# EasyEDA Pro project 嵌入式.eprj, board 显示 (continued)
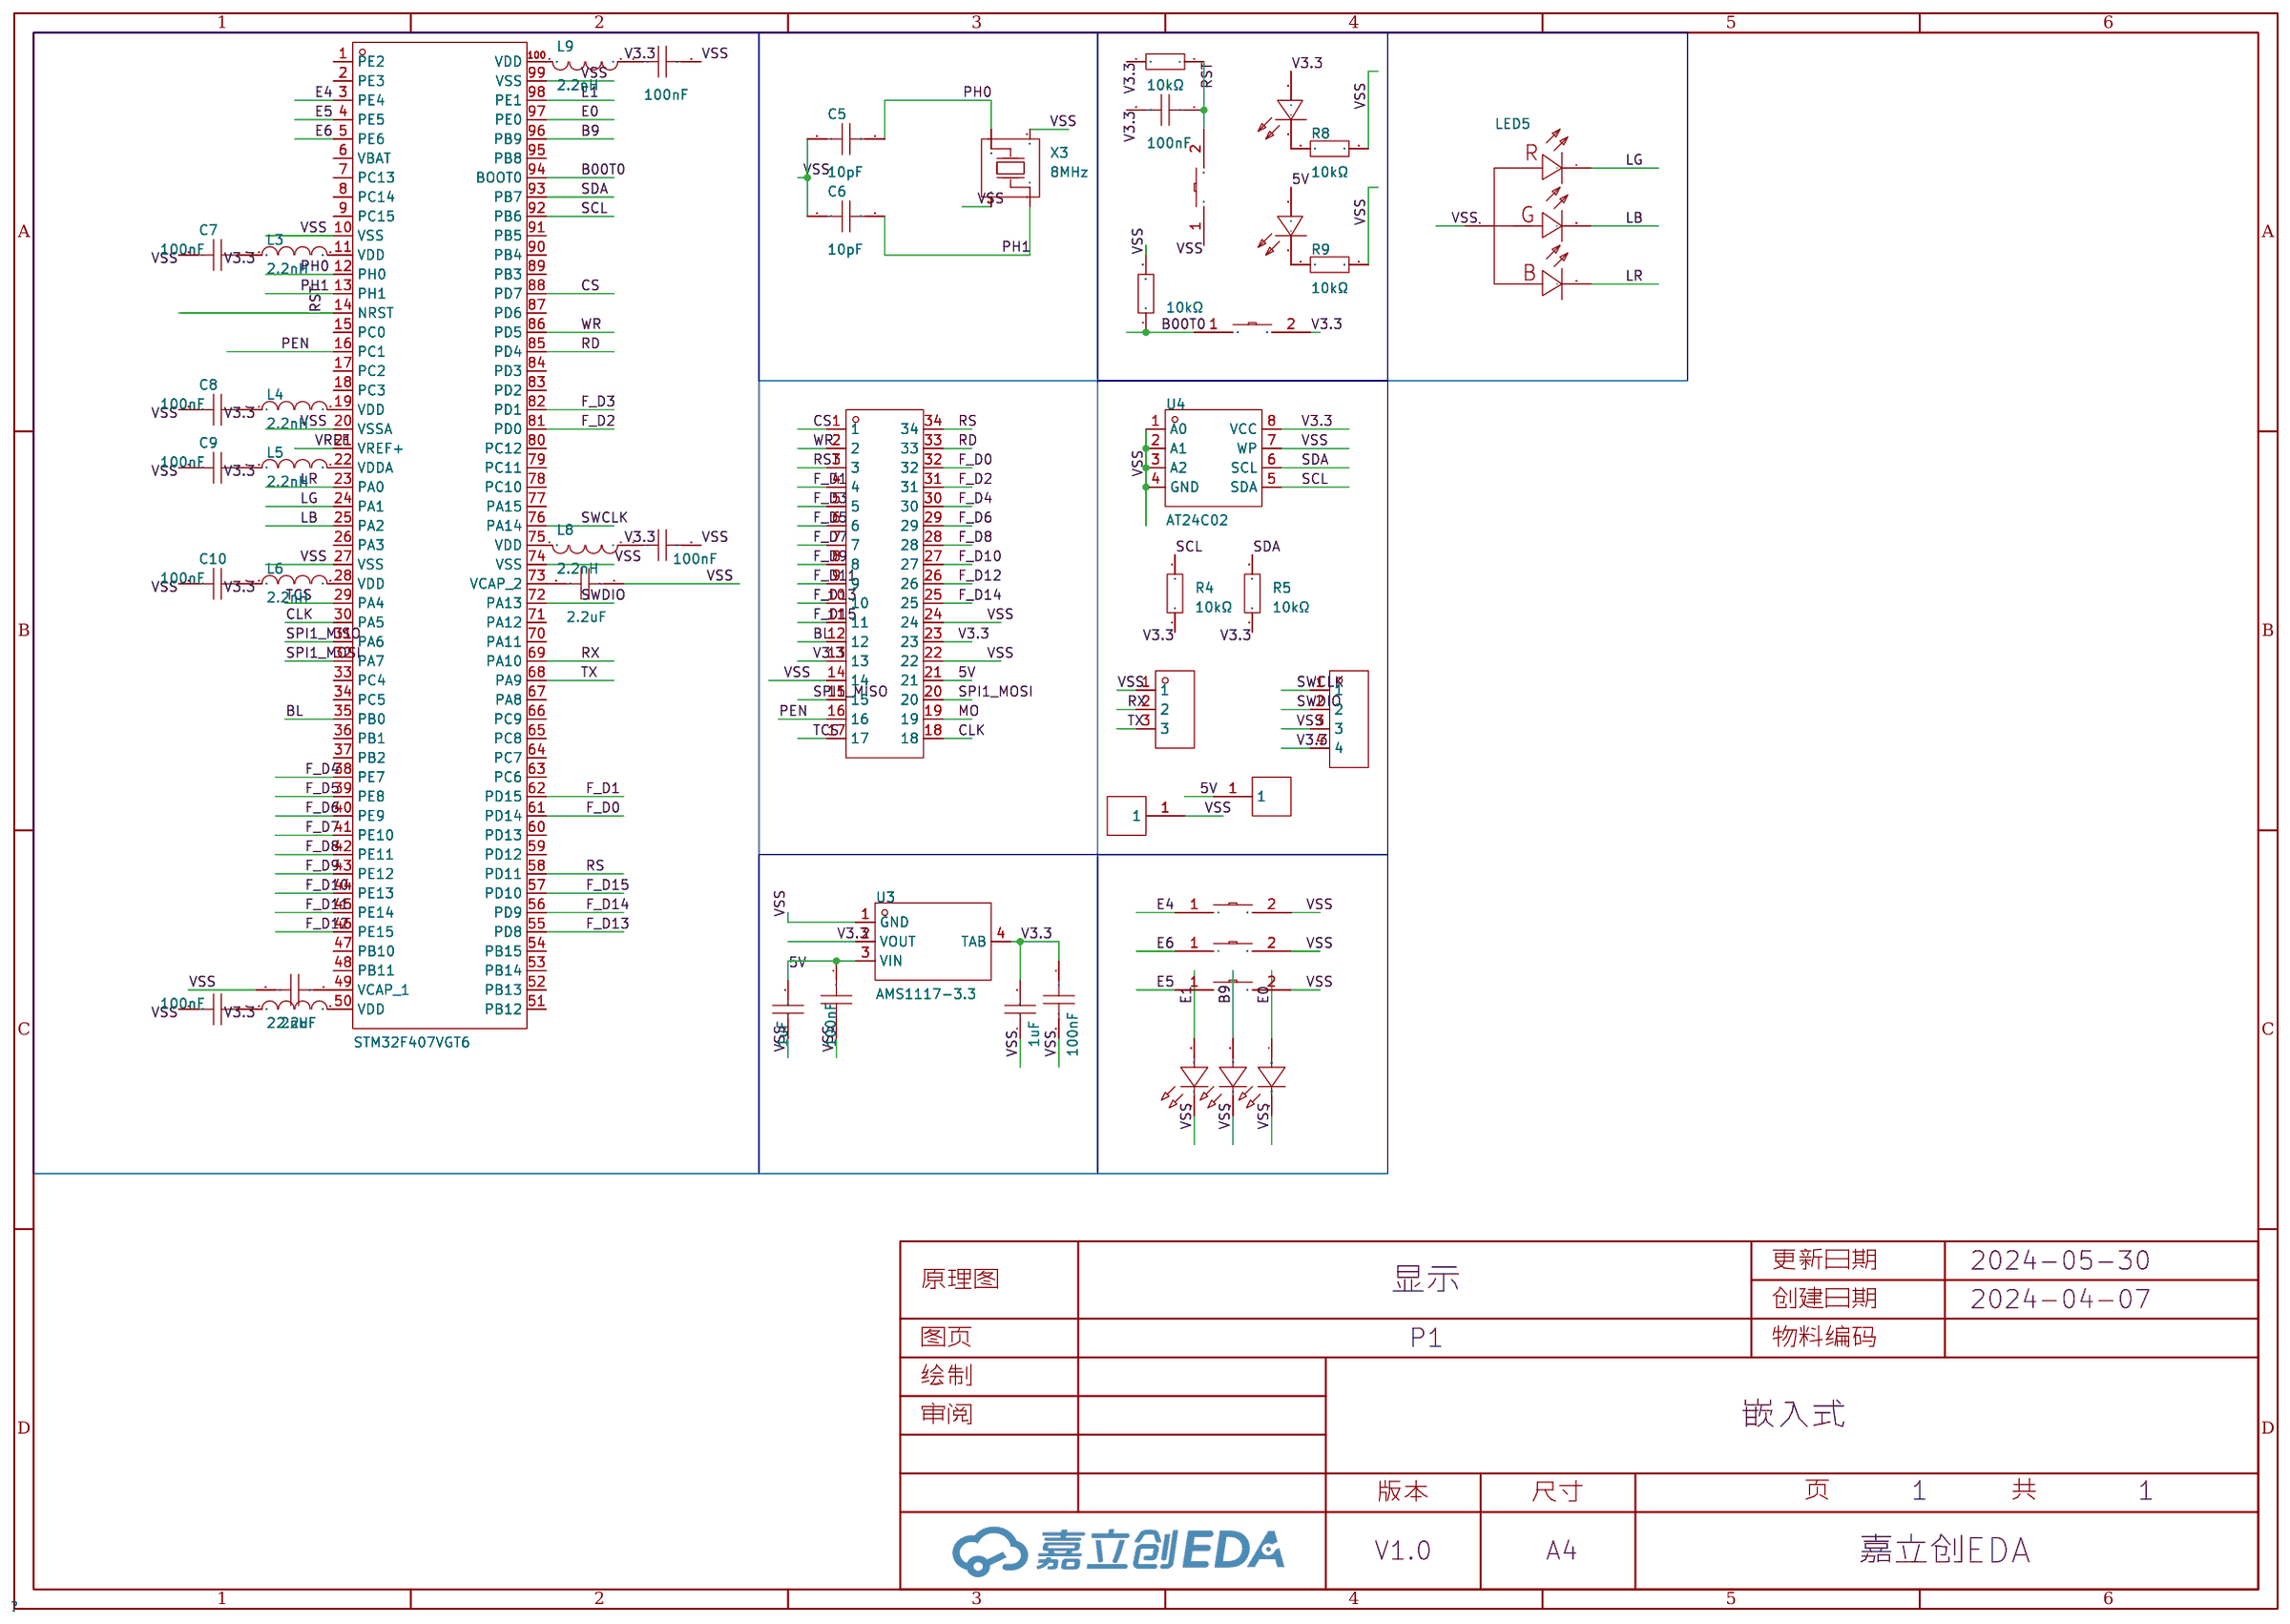
[diagram p0: schematic sheet]
## Routing (per net, layer and track width the routed paths; a pad name or vN(x,y) marks a point on that pad's centre or on a via; arc(x,y) is an arc through that point)
5V: length 166.9
  Top Layer w0.165: v3(25.49,10.33) 23.41,12.42 21.22,12.42 LED3.1
  Bottom Layer w0.381: U3.3 26.15,13.59 C18.1 25.59,11.89 C19.2 25.59,5.55 H2.1 ; NOREF#2.2 27.07,0.51 1.8,0.51 0.49,1.82 0.49,79.38 3.17,82.07 35.97,82.07 38.16,79.87
V3.3: length 186.8
  Top Layer w0.165: R4.1 30.99,28.45 v3(30.99,26.03) ; LED2.1 28.98,15.54 v3(30.66,17.22) ; SW3.2 42.88,43.88 v3(38.98,43.88) ; 31.83,26.03 R5.1
  Top Layer w0.254: 23.89,31.94 23.95,31.94 C12.1 25.25,30.61 v3(24.33,29.69) ; v3(30.11,56.45) 28.46,54.8 28.46,54.77 ; v3(11.18,42.8) 11.18,43.68 ; 11.18,43.68 C11.1 ; 11.18,43.68 11.23,43.74 L7.1 ; L3.1 36.16,46.29 v3(36.21,46.29) ; L6.1 22.97,55.16 C10.1 22.08,56.42 v3(24.14,58.48) 25.67,56.96 25.67,56.81 ; 37.58,42.1 37.58,42.48 v3(38.98,43.88) ; U4.8 35.66,26.03 v3(30.99,26.03)
  Bottom Layer w0.381: R6.2 49.23,71.37 41.62,71.37 U2.13 ; H1.4 30.99,10.84 U3.2 U3.4 ; U2.13 U2.23 ; U2.13 23.04,64.71 23.04,59.66 25.02,57.68 28.55,57.68 29.97,56.26 29.97,52.5 36.4,46.08 36.94,46.08 39.5,43.52 39.5,42.19 31.05,33.74 C20.1 30.99,27.04 v3(30.99,26.03) U3.4 ; U3.4 24.33,28.72 v3(24.33,29.69) 11.23,42.8 v3(11.18,42.8)
VSS: length 10.4
  Top Layer w0.165: v2(22.91,33.32) 22.91,33.6 U1.74 ; v2(25.17,53.9) 25.17,52.63 24.61,52.07 24.47,52.07 U1.27 ; v2(36.25,41.3) 35.24,41.3 U1.99 ; U1.20 26.37,49.78 25.2,49.78
  vias: v1(1.27,81.33) v1(1.27,79.3) v1(1.27,78.28) v1(1.27,77.27) v1(1.27,42.72) v1(1.27,41.71) v1(1.27,40.69) v1(1.27,39.67) v1(1.27,38.66) v1(1.27,37.64) v1(1.27,36.63) v1(1.27,35.61) v1(1.27,34.59) v1(1.27,33.58) v1(1.27,32.56) v1(1.27,31.55) v1(1.27,30.53) v1(1.27,29.51) v1(1.27,28.5) v1(1.27,27.48) v1(1.27,26.47) v1(1.27,25.45) v1(1.27,24.43) v1(1.27,23.42) v1(1.27,22.4) v1(1.27,21.39) v1(1.27,20.37) v1(1.27,19.35) v1(1.27,18.34) v1(1.27,17.32) v1(1.27,16.31) v1(1.27,15.29) v1(1.27,14.27) v1(1.27,13.26) v1(1.27,12.24) v1(1.27,11.23) v1(1.27,10.21) v1(1.27,9.19) v1(1.27,8.18) v1(1.27,7.16) v1(1.27,6.15) v1(1.27,5.13) v1(2.29,80.31) v1(2.29,79.3) v1(2.29,78.28) v1(2.29,76.25) v1(2.29,75.23) v1(2.29,74.22) v1(2.29,73.2) v1(2.29,72.19) v1(2.29,71.17) v1(2.29,70.15) v1(2.29,69.14) v1(2.29,68.12) v1(2.29,67.11) v1(2.29,66.09) v1(2.29,65.07) v1(2.29,64.06) v1(2.29,63.04) v1(2.29,62.03) v1(2.29,61.01) v1(2.29,59.99) v1(2.29,58.98) v1(2.29,57.96) v1(2.29,56.95) v1(2.29,55.93) v1(2.29,54.91) v1(2.29,53.9) v1(2.29,52.88) v1(2.29,51.87) v1(2.29,50.85) v1(2.29,49.83) v1(2.29,48.82) v1(2.29,47.8) v1(2.29,46.79) v1(2.29,45.77) v1(2.29,44.75) v1(2.29,41.71) v1(2.29,40.69) v1(2.29,39.67) v1(2.29,38.66) v1(2.29,37.64) v1(2.29,36.63) v1(2.29,35.61) v1(2.29,34.59) v1(2.29,33.58) v1(2.29,32.56) v1(2.29,31.55) v1(2.29,30.53) v1(2.29,29.51) v1(2.29,28.5) v1(2.29,27.48) v1(2.29,26.47) v1(2.29,25.45) v1(2.29,24.43) v1(2.29,23.42) v1(2.29,22.4) v1(2.29,21.39) v1(2.29,20.37) v1(2.29,19.35) v1(2.29,18.34) v1(2.29,17.32) v1(2.29,16.31) v1(2.29,15.29) v1(2.29,14.27) v1(2.29,13.26) v1(2.29,12.24) v1(2.29,11.23) v1(2.29,10.21) v1(2.29,9.19) v1(2.29,8.18) v1(2.29,7.16) v1(2.29,6.15) v1(3.3,81.33) v1(3.3,80.31) v1(3.3,79.3) v1(3.3,77.27) v1(3.3,76.25) v1(3.3,75.23) v1(3.3,74.22) v1(3.3,73.2) v1(3.3,72.19) v1(3.3,71.17) v1(3.3,70.15) v1(3.3,69.14) v1(3.3,68.12) v1(3.3,67.11) v1(3.3,66.09) v1(3.3,65.07) v1(3.3,64.06) v1(3.3,63.04) v1(3.3,62.03) v1(3.3,61.01) v1(3.3,59.99) v1(3.3,58.98) v1(3.3,57.96) v1(3.3,56.95) v1(3.3,55.93) v1(3.3,54.91) v1(3.3,53.9) v1(3.3,52.88) v1(3.3,51.87) v1(3.3,50.85) v1(3.3,49.83) v1(3.3,48.82) v1(3.3,47.8) v1(3.3,46.79) v1(3.3,45.77) v1(3.3,44.75) v1(3.3,43.74) v1(3.3,40.69) v1(3.3,39.67) v1(3.3,38.66) v1(3.3,37.64) v1(3.3,36.63) v1(3.3,35.61) v1(3.3,34.59) v1(3.3,33.58) v1(3.3,32.56) v1(3.3,31.55) v1(3.3,30.53) v1(3.3,29.51) v1(3.3,28.5) v1(3.3,27.48) v1(3.3,26.47) v1(3.3,25.45) v1(3.3,24.43) v1(3.3,23.42) v1(3.3,22.4) v1(3.3,21.39) v1(3.3,20.37) v1(3.3,19.35) v1(3.3,18.34) v1(3.3,17.32) v1(3.3,16.31) v1(3.3,15.29) v1(3.3,14.27) v1(3.3,13.26) v1(3.3,12.24) v1(3.3,11.23) v1(3.3,10.21) v1(3.3,9.19) v1(3.3,8.18) v1(3.3,7.16) v1(3.3,6.15) v1(4.32,81.33) v1(4.32,75.23) v1(4.32,74.22) v1(4.32,73.2) v1(4.32,72.19) v1(4.32,71.17) v1(4.32,70.15) v1(4.32,69.14) v1(4.32,68.12) v1(4.32,67.11) v1(4.32,66.09) v1(4.32,65.07) v1(4.32,64.06) v1(4.32,63.04) v1(4.32,62.03) v1(4.32,61.01) v1(4.32,59.99) v1(4.32,58.98) v1(4.32,57.96) v1(4.32,56.95) v1(4.32,55.93) v1(4.32,54.91) v1(4.32,53.9) v1(4.32,52.88) v1(4.32,51.87) v1(4.32,50.85) v1(4.32,49.83) v1(4.32,48.82) v1(4.32,47.8) v1(4.32,46.79) v1(4.32,45.77) v1(4.32,44.75) v1(4.32,43.74) v1(4.32,42.72) v1(4.32,39.67) v1(4.32,38.66) v1(4.32,37.64) v1(4.32,36.63) v1(4.32,35.61) v1(4.32,34.59) v1(4.32,33.58) v1(4.32,32.56) v1(4.32,31.55) v1(4.32,30.53) v1(4.32,29.51) v1(4.32,28.5) v1(4.32,27.48) v1(4.32,26.47) v1(4.32,25.45) v1(4.32,24.43) v1(4.32,23.42) v1(4.32,22.4) v1(4.32,21.39) v1(4.32,20.37) v1(4.32,19.35) v1(4.32,18.34) v1(4.32,17.32) v1(4.32,16.31) v1(4.32,15.29) v1(4.32,14.27) v1(4.32,13.26) v1(4.32,12.24) v1(4.32,11.23) v1(4.32,10.21) v1(4.32,9.19) v1(4.32,8.18) v1(4.32,7.16) v1(4.32,6.15) v1(5.33,81.33) v1(5.33,38.66) v1(5.33,37.64) v1(5.33,36.63) v1(5.33,35.61) v1(5.33,34.59) v1(5.33,33.58) v1(5.33,32.56) v1(5.33,31.55) v1(5.33,30.53) v1(5.33,29.51) v1(5.33,28.5) v1(5.33,27.48) v1(5.33,26.47) v1(5.33,25.45) v1(5.33,24.43) v1(5.33,23.42) v1(5.33,22.4) v1(5.33,21.39) v1(5.33,20.37) v1(5.33,19.35) v1(5.33,18.34) v1(5.33,17.32) v1(5.33,16.31) v1(5.33,15.29) v1(5.33,14.27) v1(5.33,13.26) v1(5.33,12.24) v1(5.33,11.23) v1(5.33,10.21) v1(5.33,9.19) v1(5.33,8.18) v1(5.33,7.16) v1(5.33,6.15) v1(5.33,5.13) v1(6.35,81.33) v1(6.35,75.23) v1(6.35,74.22) v1(6.35,73.2) v1(6.35,72.19) v1(6.35,71.17) v1(6.35,70.15) v1(6.35,69.14) v1(6.35,68.12) v1(6.35,67.11) v1(6.35,66.09) v1(6.35,65.07) v1(6.35,64.06) v1(6.35,63.04) v1(6.35,62.03) v1(6.35,61.01) v1(6.35,59.99) v1(6.35,58.98) v1(6.35,57.96) v1(6.35,56.95) v1(6.35,55.93) v1(6.35,54.91) v1(6.35,53.9) v1(6.35,52.88) v1(6.35,51.87) v1(6.35,50.85) v1(6.35,49.83) v1(6.35,48.82) v1(6.35,47.8) v1(6.35,46.79) v1(6.35,45.77) v1(6.35,44.75) v1(6.35,43.74) v1(6.35,42.72) v1(6.35,41.71) v1(6.35,37.64) v1(6.35,36.63) v1(6.35,35.61) v1(6.35,34.59) v1(6.35,33.58) v1(6.35,32.56) v1(6.35,31.55) v1(6.35,30.53) v1(6.35,29.51) v1(6.35,28.5) v1(6.35,27.48) v1(6.35,26.47) v1(6.35,25.45) v1(6.35,24.43) v1(6.35,23.42) v1(6.35,22.4) v1(6.35,21.39) v1(6.35,20.37) v1(6.35,19.35) v1(6.35,18.34) v1(6.35,17.32) v1(6.35,16.31) v1(6.35,15.29) v1(6.35,14.27) v1(6.35,13.26) v1(6.35,12.24) v1(6.35,11.23) v1(6.35,10.21) v1(6.35,9.19) v1(6.35,8.18) v1(6.35,7.16) v1(6.35,6.15) v1(6.35,5.13) v1(6.35,4.11) v1(6.35,3.1) v1(6.35,2.08) v1(7.37,81.33) v1(7.37,53.9) v1(7.37,52.88) v1(7.37,51.87) v1(7.37,50.85) v1(7.37,49.83) v1(7.37,48.82) v1(7.37,47.8) v1(7.37,46.79) v1(7.37,45.77) v1(7.37,44.75) v1(7.37,43.74) v1(7.37,42.72) v1(7.37,41.71) v1(7.37,40.69) v1(7.37,36.63) v1(7.37,35.61) v1(7.37,34.59) v1(7.37,33.58) v1(7.37,32.56) v1(7.37,31.55) v1(7.37,30.53) v1(7.37,29.51) v1(7.37,28.5) v1(7.37,27.48) v1(7.37,26.47) v1(7.37,25.45) v1(7.37,24.43) v1(7.37,23.42) v1(7.37,22.4) v1(7.37,21.39) v1(7.37,20.37) v1(7.37,19.35) v1(7.37,18.34) v1(7.37,17.32) v1(7.37,16.31) v1(7.37,15.29) v1(7.37,14.27) v1(7.37,13.26) v1(7.37,12.24) v1(7.37,11.23) v1(7.37,10.21) v1(7.37,9.19) v1(7.37,8.18) v1(7.37,7.16) v1(7.37,6.15) v1(7.37,5.13) v1(7.37,4.11) v1(7.37,3.1) v1(7.37,2.08) v1(8.38,81.33) v1(8.38,75.23) v1(8.38,74.22) v1(8.38,73.2) v1(8.38,72.19) v1(8.38,71.17) v1(8.38,70.15) v1(8.38,69.14) v1(8.38,68.12) v1(8.38,67.11) v1(8.38,66.09) v1(8.38,65.07) v1(8.38,64.06) v1(8.38,63.04) v1(8.38,62.03) v1(8.38,61.01) v1(8.38,59.99) v1(8.38,58.98) v1(8.38,57.96) v1(8.38,56.95) v1(8.38,55.93) v1(8.38,52.88) v1(8.38,51.87) v1(8.38,50.85) v1(8.38,49.83) v1(8.38,48.82) v1(8.38,47.8) v1(8.38,46.79) v1(8.38,45.77) v1(8.38,44.75) v1(8.38,43.74) v1(8.38,42.72) v1(8.38,41.71) v1(8.38,40.69) v1(8.38,39.67) v1(8.38,35.61) v1(8.38,34.59) v1(8.38,33.58) v1(8.38,32.56) v1(8.38,31.55) v1(8.38,30.53) v1(8.38,29.51) v1(8.38,28.5) v1(8.38,27.48) v1(8.38,26.47) v1(8.38,25.45) v1(8.38,24.43) v1(8.38,23.42) v1(8.38,22.4) v1(8.38,21.39) v1(8.38,20.37) v1(8.38,19.35) v1(8.38,18.34) v1(8.38,17.32) v1(8.38,16.31) v1(8.38,15.29) v1(8.38,14.27) v1(8.38,13.26) v1(8.38,12.24) v1(8.38,11.23) v1(8.38,10.21) v1(8.38,9.19) v1(8.38,8.18) v1(8.38,7.16) v1(8.38,6.15) v1(8.38,5.13) v1(8.38,4.11) v1(8.38,3.1) v1(8.38,2.08) v1(9.4,81.33) v1(9.4,51.87) v1(9.4,50.85) v1(9.4,49.83) v1(9.4,48.82) v1(9.4,47.8) v1(9.4,46.79) v1(9.4,45.77) v1(9.4,44.75) v1(9.4,42.72) v1(9.4,41.71) v1(9.4,40.69) v1(9.4,39.67) v1(9.4,38.66) v1(9.4,35.61) v1(9.4,34.59) v1(9.4,33.58) v1(9.4,32.56) v1(9.4,31.55) v1(9.4,30.53) v1(9.4,29.51) v1(9.4,28.5) v1(9.4,27.48) v1(9.4,26.47) v1(9.4,25.45) v1(9.4,24.43) v1(9.4,23.42) v1(9.4,22.4) v1(9.4,21.39) v1(9.4,20.37) v1(9.4,19.35) v1(9.4,18.34) v1(9.4,17.32) v1(9.4,16.31) v1(9.4,15.29) v1(9.4,14.27) v1(9.4,13.26) v1(9.4,12.24) v1(9.4,11.23) v1(9.4,10.21) v1(9.4,9.19) v1(9.4,8.18) v1(9.4,7.16) v1(9.4,6.15) v1(9.4,5.13) v1(9.4,4.11) v1(9.4,3.1) v1(9.4,2.08) v1(10.41,81.33) v1(10.41,75.23) v1(10.41,74.22) v1(10.41,73.2) v1(10.41,72.19) v1(10.41,71.17) v1(10.41,70.15) v1(10.41,69.14) v1(10.41,68.12) v1(10.41,67.11) v1(10.41,66.09) v1(10.41,65.07) v1(10.41,63.04) v1(10.41,62.03) v1(10.41,61.01) v1(10.41,59.99) v1(10.41,58.98) v1(10.41,57.96) v1(10.41,56.95) v1(10.41,55.93) v1(10.41,54.91) v1(10.41,50.85) v1(10.41,49.83) v1(10.41,48.82) v1(10.41,45.77) v1(10.41,44.75) v1(10.41,40.69) v1(10.41,39.67) v1(10.41,38.66) v1(10.41,37.64) v1(10.41,35.61) v1(10.41,34.59) v1(10.41,33.58) v1(10.41,32.56) v1(10.41,31.55) v1(10.41,30.53) v1(10.41,29.51) v1(10.41,28.5) v1(10.41,27.48) v1(10.41,26.47) v1(10.41,25.45) v1(10.41,24.43) v1(10.41,23.42) v1(10.41,22.4) v1(10.41,21.39) v1(10.41,20.37) v1(10.41,19.35) v1(10.41,18.34) v1(10.41,17.32) v1(10.41,16.31) v1(10.41,15.29) v1(10.41,14.27) v1(10.41,13.26) v1(10.41,12.24) v1(10.41,11.23) v1(10.41,10.21) v1(10.41,9.19) v1(10.41,8.18) v1(10.41,7.16) v1(10.41,6.15) v1(10.41,5.13) v1(10.41,4.11) v1(10.41,3.1) v1(10.41,2.08) v1(11.43,39.67) v1(11.43,38.66) v1(11.43,37.64) v1(11.43,34.59) v1(11.43,33.58) v1(11.43,32.56) v1(11.43,31.55) v1(11.43,30.53) v1(11.43,29.51) v1(11.43,28.5) v1(11.43,27.48) v1(11.43,26.47) v1(11.43,25.45) v1(11.43,24.43) v1(11.43,23.42) v1(11.43,22.4) v1(11.43,21.39) v1(11.43,20.37) v1(11.43,19.35) v1(11.43,18.34) v1(11.43,17.32) v1(11.43,16.31) v1(11.43,15.29) v1(11.43,14.27) v1(11.43,13.26) v1(11.43,12.24) v1(11.43,11.23) v1(11.43,10.21) v1(11.43,9.19) v1(11.43,8.18) v1(11.43,7.16) v1(11.43,6.15) v1(11.43,5.13) v1(11.43,4.11) v1(11.43,3.1) v1(11.43,2.08) v1(12.45,75.23) v1(12.45,74.22) v1(12.45,73.2) v1(12.45,72.19) v1(12.45,71.17) v1(12.45,70.15) v1(12.45,69.14) v1(12.45,68.12) v1(12.45,67.11) v1(12.45,66.09) v1(12.45,65.07) v1(12.45,64.06) v1(12.45,63.04) v1(12.45,62.03) v1(12.45,61.01) v1(12.45,59.99) v1(12.45,58.98) v1(12.45,57.96) v1(12.45,56.95) v1(12.45,55.93) v1(12.45,54.91) v1(12.45,53.9) v1(12.45,52.88) v1(12.45,48.82) v1(12.45,38.66) v1(12.45,37.64) v1(12.45,35.61) v1(12.45,33.58) v1(12.45,32.56) v1(12.45,31.55) v1(12.45,30.53) v1(12.45,29.51) v1(12.45,28.5) v1(12.45,9.19) v1(12.45,8.18) v1(12.45,7.16) v1(12.45,6.15) v1(12.45,5.13) v1(12.45,4.11) v1(12.45,3.1) v1(12.45,2.08) v1(13.46,81.33) v1(13.46,37.64) v1(13.46,35.61) v1(13.46,34.59) v1(13.46,32.56) v1(13.46,31.55) v1(13.46,30.53) v1(13.46,29.51) v1(13.46,8.18) v1(13.46,7.16) v1(13.46,6.15) v1(13.46,5.13) v1(13.46,4.11) v1(13.46,3.1) v1(13.46,2.08) v1(14.48,81.33) v1(14.48,35.61) v1(14.48,34.59) v1(14.48,33.58) v1(14.48,31.55) v1(14.48,30.53) v1(14.48,27.48) v1(14.48,26.47) v1(14.48,25.45) v1(14.48,24.43) v1(14.48,23.42) v1(14.48,22.4) v1(14.48,21.39) v1(14.48,20.37) v1(14.48,19.35) v1(14.48,18.34) v1(14.48,17.32) v1(14.48,16.31) v1(14.48,14.27) v1(14.48,13.26) v1(14.48,7.16) v1(14.48,6.15) v1(14.48,5.13) v1(14.48,4.11) v1(14.48,3.1) v1(14.48,2.08) v1(15.49,81.33) v1(15.49,35.61) v1(15.49,34.59) v1(15.49,33.58) v1(15.49,31.55) v1(15.49,28.5) v1(15.49,27.48) v1(15.49,26.47) v1(15.49,25.45) v1(15.49,24.43) v1(15.49,23.42) v1(15.49,22.4) v1(15.49,21.39) v1(15.49,20.37) v1(15.49,19.35) v1(15.49,18.34) v1(15.49,17.32) v1(15.49,14.27) v1(15.49,11.23) v1(15.49,6.15) v1(15.49,5.13) v1(15.49,4.11) v1(15.49,3.1) v1(15.49,2.08) v1(16.51,81.33) v1(16.51,34.59) v1(16.51,33.58) v1(16.51,29.51) v1(16.51,28.5) v1(16.51,27.48) v1(16.51,26.47) v1(16.51,25.45) v1(16.51,24.43) v1(16.51,23.42) v1(16.51,22.4) v1(16.51,21.39) v1(16.51,20.37) v1(16.51,19.35) v1(16.51,18.34) v1(16.51,17.32) v1(16.51,14.27) v1(16.51,11.23) v1(16.51,6.15) v1(16.51,5.13) v1(16.51,4.11) v1(16.51,3.1) v1(16.51,2.08) v1(17.53,81.33) v1(17.53,35.61) v1(17.53,34.59) v1(17.53,33.58) v1(17.53,30.53) v1(17.53,29.51) v1(17.53,28.5) v1(17.53,27.48) v1(17.53,26.47) v1(17.53,25.45) v1(17.53,24.43) v1(17.53,23.42) v1(17.53,22.4) v1(17.53,21.39) v1(17.53,20.37) v1(17.53,19.35) v1(17.53,18.34) v1(17.53,17.32) v1(17.53,16.31) v1(17.53,14.27) v1(17.53,13.26) v1(17.53,11.23) v1(17.53,6.15) v1(17.53,5.13) v1(17.53,4.11) v1(17.53,3.1) v1(17.53,2.08) v1(18.54,81.33) v1(18.54,36.63) v1(18.54,34.59) v1(18.54,31.55) v1(18.54,30.53) v1(18.54,29.51) v1(18.54,28.5) v1(18.54,27.48) v1(18.54,26.47) v1(18.54,25.45) v1(18.54,24.43) v1(18.54,23.42) v1(18.54,22.4) v1(18.54,21.39) v1(18.54,20.37) v1(18.54,19.35) v1(18.54,18.34) v1(18.54,17.32) v1(18.54,11.23) v1(18.54,10.21) v1(18.54,6.15) v1(18.54,5.13) v1(18.54,4.11) v1(18.54,3.1) v1(18.54,2.08) v1(19.56,81.33) v1(19.56,35.61) v1(19.56,25.45) v1(19.56,24.43) v1(19.56,23.42) v1(19.56,22.4) v1(19.56,21.39) v1(19.56,20.37) v1(19.56,19.35) v1(19.56,18.34) v1(19.56,17.32) v1(19.56,11.23) v1(19.56,10.21) v1(19.56,9.19) v1(19.56,6.15) v1(19.56,5.13) v1(19.56,4.11) v1(19.56,3.1) v1(19.56,2.08) v1(20.57,81.33) v1(20.57,40.69) v1(20.57,29.51) v1(20.57,28.5) v1(20.57,27.48) v1(20.57,24.43) v1(20.57,23.42) v1(20.57,22.4) v1(20.57,21.39) v1(20.57,20.37) v1(20.57,19.35) v1(20.57,18.34) v1(20.57,17.32) v1(20.57,11.23) v1(20.57,10.21) v1(20.57,9.19) v1(20.57,6.15) v1(20.57,5.13) v1(20.57,4.11) v1(20.57,3.1) v1(20.57,2.08) v1(21.59,81.33) v1(21.59,39.67) v1(21.59,27.48) v1(21.59,26.47) v1(21.59,23.42) v1(21.59,22.4) v1(21.59,21.39) v1(21.59,20.37) v1(21.59,19.35) v1(21.59,18.34) v1(21.59,17.32) v1(21.59,11.23) v1(21.59,10.21) v1(21.59,9.19) v1(21.59,6.15) v1(21.59,5.13) v1(21.59,4.11) v1(21.59,3.1) v1(21.59,2.08) v1(22.61,81.33) v1(22.61,73.2) v1(22.61,72.19) v1(22.61,71.17) v1(22.61,70.15) v1(22.61,69.14) v1(22.61,68.12) v1(22.61,67.11) v1(22.61,66.09) v1(22.61,47.8) v1(22.61,42.72) v1(22.61,38.66) v1(22.61,29.51) v1(22.61,28.5) v1(22.61,27.48) v1(22.61,26.47) v1(22.61,25.45) v1(22.61,22.4) v1(22.61,21.39) v1(22.61,20.37) v1(22.61,19.35) v1(22.61,18.34) v1(22.61,17.32) v1(22.61,16.31) v1(22.61,14.27) v1(22.61,13.26) v1(22.61,11.23) v1(22.61,10.21) v1(22.61,9.19) v1(22.61,6.15) v1(22.61,5.13) v1(22.61,4.11) v1(22.61,3.1) v1(22.61,2.08) v1(23.62,81.33) v1(23.62,74.22) v1(23.62,73.2) v1(23.62,72.19) v1(23.62,71.17) v1(23.62,70.15) v1(23.62,69.14) v1(23.62,68.12) v1(23.62,67.11) v1(23.62,48.82) v1(23.62,47.8) v1(23.62,43.74) v1(23.62,42.72) v1(23.62,41.71) v1(23.62,38.66) v1(23.62,37.64) v1(23.62,28.5) v1(23.62,27.48) v1(23.62,26.47) v1(23.62,25.45) v1(23.62,24.43) v1(23.62,21.39) v1(23.62,20.37) v1(23.62,19.35) v1(23.62,18.34) v1(23.62,17.32) v1(23.62,16.31) v1(23.62,14.27) v1(23.62,13.26) v1(23.62,10.21) v1(23.62,9.19) v1(23.62,6.15) v1(23.62,5.13) v1(23.62,4.11) v1(23.62,3.1) v1(23.62,2.08) v1(24.64,81.33) v1(24.64,75.23) v1(24.64,74.22) v1(24.64,73.2) v1(24.64,72.19) v1(24.64,71.17) v1(24.64,70.15) v1(24.64,69.14) v1(24.64,68.12) v1(24.64,65.07) v1(24.64,64.06) v1(24.64,63.04) v1(24.64,59.99) v1(24.64,55.93) v1(24.64,48.82) v1(24.64,44.75) v1(24.64,43.74) v1(24.64,42.72) v1(24.64,41.71) v1(24.64,38.66) v1(24.64,37.64) v1(24.64,27.48) v1(24.64,26.47) v1(24.64,25.45) v1(24.64,24.43) v1(24.64,23.42) v1(24.64,20.37) v1(24.64,19.35) v1(24.64,18.34) v1(24.64,17.32) v1(24.64,16.31) v1(24.64,14.27) v1(24.64,13.26) v1(24.64,12.24) v1(24.64,9.19) v1(24.64,8.18) v1(24.64,7.16) v1(24.64,6.15) v1(24.64,5.13) v1(24.64,4.11) v1(24.64,3.1) v1(24.64,2.08) v1(25.65,81.33) v1(25.65,75.23) v1(25.65,74.22) v1(25.65,73.2) v1(25.65,72.19) v1(25.65,71.17) v1(25.65,70.15) v1(25.65,69.14) v1(25.65,66.09) v1(25.65,65.07) v1(25.65,64.06) v1(25.65,61.01) v1(25.65,59.99) v1(25.65,49.83) v1(25.65,45.77) v1(25.65,44.75) v1(25.65,43.74) v1(25.65,42.72) v1(25.65,41.71) v1(25.65,38.66) v1(25.65,37.64) v1(25.65,29.51) v1(25.65,28.5) v1(25.65,26.47) v1(25.65,25.45) v1(25.65,24.43) v1(25.65,23.42) v1(25.65,22.4) v1(25.65,19.35) v1(25.65,18.34) v1(25.65,17.32) v1(25.65,16.31) v1(25.65,14.27) v1(25.65,4.11) v1(25.65,3.1) v1(25.65,2.08) v1(26.67,81.33) v1(26.67,46.79) v1(26.67,45.77) v1(26.67,43.74) v1(26.67,42.72) v1(26.67,41.71) v1(26.67,38.66) v1(26.67,30.53) v1(26.67,29.51) v1(26.67,28.5) v1(26.67,27.48) v1(26.67,25.45) v1(26.67,24.43) v1(26.67,23.42) v1(26.67,22.4) v1(26.67,21.39) v1(26.67,18.34) v1(26.67,17.32) v1(26.67,16.31) v1(26.67,11.23) v1(26.67,9.19) v1(26.67,6.15) v1(26.67,3.1) v1(26.67,2.08) v1(27.69,81.33) v1(27.69,47.8) v1(27.69,46.79) v1(27.69,45.77) v1(27.69,44.75) v1(27.69,43.74) v1(27.69,42.72) v1(27.69,41.71) v1(27.69,40.69) v1(27.69,31.55) v1(27.69,30.53) v1(27.69,29.51) v1(27.69,28.5) v1(27.69,27.48) v1(27.69,26.47) v1(27.69,24.43) v1(27.69,23.42) v1(27.69,22.4) v1(27.69,21.39) v1(27.69,18.34) v1(27.69,17.32) v1(27.69,16.31) v1(27.69,14.27) v1(27.69,13.26) v1(27.69,9.19) v1(27.69,5.13) v1(28.7,81.33) v1(28.7,75.23) v1(28.7,74.22) v1(28.7,73.2) v1(28.7,72.19) v1(28.7,69.14) v1(28.7,68.12) v1(28.7,67.11) v1(28.7,64.06) v1(28.7,63.04) v1(28.7,59.99) v1(28.7,47.8) v1(28.7,46.79) v1(28.7,45.77) v1(28.7,44.75) v1(28.7,43.74) v1(28.7,42.72) v1(28.7,41.71) v1(28.7,40.69) v1(28.7,39.67) v1(28.7,23.42) v1(28.7,22.4) v1(28.7,21.39) v1(28.7,18.34) v1(28.7,14.27) v1(28.7,13.26) v1(28.7,12.24) v1(28.7,11.23) v1(28.7,10.21) v1(28.7,6.15) v1(28.7,5.13) v1(29.72,81.33) v1(29.72,75.23) v1(29.72,74.22) v1(29.72,73.2) v1(29.72,70.15) v1(29.72,69.14) v1(29.72,68.12) v1(29.72,65.07) v1(29.72,64.06) v1(29.72,61.01) v1(29.72,46.79) v1(29.72,45.77) v1(29.72,43.74) v1(29.72,42.72) v1(29.72,41.71) v1(29.72,40.69) v1(29.72,39.67) v1(29.72,32.56) v1(29.72,31.55) v1(29.72,30.53) v1(29.72,29.51) v1(29.72,27.48) v1(29.72,26.47) v1(29.72,18.34) v1(29.72,17.32) v1(29.72,15.29) v1(29.72,14.27) v1(29.72,13.26) v1(29.72,12.24) v1(29.72,11.23) v1(29.72,6.15) v1(29.72,5.13) v1(29.72,4.11) v1(29.72,3.1) v1(29.72,2.08) v1(29.72,1.07) v1(30.73,81.33) v1(30.73,41.71) v1(30.73,40.69) v1(30.73,9.19) v1(30.73,6.15) v1(30.73,5.13) v1(30.73,4.11) v1(30.73,3.1) v1(30.73,2.08) v1(30.73,1.07) v1(31.75,81.33) v1(31.75,79.3) v1(31.75,78.28) v1(31.75,76.25) v1(31.75,75.23) v1(31.75,72.19) v1(31.75,71.17) v1(31.75,70.15) v1(31.75,67.11) v1(31.75,63.04) v1(31.75,51.87) v1(31.75,41.71) v1(31.75,33.58) v1(31.75,32.56) v1(31.75,31.55) v1(31.75,20.37) v1(31.75,19.35) v1(31.75,14.27) v1(31.75,13.26) v1(31.75,12.24) v1(31.75,11.23) v1(31.75,10.21) v1(31.75,9.19) v1(31.75,6.15) v1(31.75,5.13) v1(31.75,4.11) v1(31.75,3.1) v1(31.75,2.08) v1(31.75,1.07) v1(32.77,81.33) v1(32.77,68.12) v1(32.77,64.06) v1(32.77,54.91) v1(32.77,42.72) v1(32.77,37.64) v1(32.77,34.59) v1(32.77,33.58) v1(32.77,32.56) v1(32.77,31.55) v1(32.77,30.53) v1(32.77,20.37) v1(32.77,19.35) v1(32.77,18.34) v1(32.77,5.13) v1(32.77,4.11) v1(32.77,3.1) v1(32.77,2.08) v1(32.77,1.07) v1(33.78,81.33) v1(33.78,69.14) v1(33.78,65.07) v1(33.78,58.98) v1(33.78,57.96) v1(33.78,55.93) v1(33.78,52.88) v1(33.78,51.87) v1(33.78,35.61) v1(33.78,34.59) v1(33.78,33.58) v1(33.78,32.56) v1(33.78,31.55) v1(33.78,23.42) v1(33.78,22.4) v1(33.78,19.35) v1(33.78,18.34) v1(33.78,14.27) v1(33.78,13.26) v1(33.78,12.24) v1(33.78,11.23) v1(33.78,10.21) v1(33.78,9.19) v1(33.78,6.15) v1(33.78,5.13) v1(34.8,81.33) v1(34.8,75.23) v1(34.8,74.22) v1(34.8,73.2) v1(34.8,72.19) v1(34.8,71.17) v1(34.8,70.15) v1(34.8,66.09) v1(34.8,59.99) v1(34.8,58.98) v1(34.8,52.88) v1(34.8,27.48) v1(34.8,24.43) v1(34.8,23.42) v1(34.8,22.4) v1(34.8,21.39) v1(34.8,5.13) v1(35.81,81.33) v1(35.81,75.23) v1(35.81,74.22) v1(35.81,73.2) v1(35.81,72.19) v1(35.81,71.17) v1(35.81,67.11) v1(35.81,61.01) v1(35.81,59.99) v1(35.81,48.82) v1(35.81,47.8) v1(35.81,27.48) v1(35.81,24.43) v1(35.81,23.42) v1(35.81,22.4) v1(35.81,21.39) v1(35.81,20.37) v1(35.81,5.13) v1(35.81,4.11) v1(35.81,3.1) v1(35.81,2.08) v1(35.81,1.07) v1(36.83,79.3) v1(36.83,78.28) v1(36.83,75.23) v1(36.83,74.22) v1(36.83,73.2) v1(36.83,72.19) v1(36.83,68.12) v1(36.83,62.03) v1(36.83,61.01) v1(36.83,56.95) v1(36.83,48.82) v1(36.83,40.69) v1(36.83,25.45) v1(36.83,24.43) v1(36.83,23.42) v1(36.83,22.4) v1(36.83,21.39) v1(36.83,20.37) v1(36.83,19.35) v1(36.83,18.34) v1(36.83,17.32) v1(36.83,16.31) v1(36.83,15.29) v1(36.83,14.27) v1(36.83,13.26) v1(36.83,12.24) v1(36.83,11.23) v1(36.83,10.21) v1(36.83,9.19) v1(36.83,8.18) v1(36.83,7.16) v1(36.83,6.15) v1(36.83,5.13) v1(36.83,4.11) v1(36.83,3.1) v1(36.83,2.08) v1(36.83,1.07) v1(37.85,81.33) v1(37.85,76.25) v1(37.85,74.22) v1(37.85,73.2) v1(37.85,69.14) v1(37.85,65.07) v1(37.85,62.03) v1(37.85,57.96) v1(37.85,56.95) v1(37.85,55.93) v1(37.85,50.85) v1(37.85,48.82) v1(37.85,47.8) v1(37.85,46.79) v1(37.85,39.67) v1(37.85,34.59) v1(37.85,33.58) v1(37.85,32.56) v1(37.85,31.55) v1(37.85,30.53) v1(37.85,29.51) v1(37.85,26.47) v1(37.85,25.45)